# Altium schematic sheet SOC_PS_PSIO.SchDoc: Title
size 420 x 297 mm; Author: G.Kasprowicz; CompanyName: WUT ISE; DrawnBy: G.Kasprowicz; Organization: WUT ISE; Address1: PW ISE; Address2: Nowowiejska 15/19 00-665 Warsaw; Address3: gkasprow@gmail.com; DocumentNumber: 11; Revision: 2; SheetNumber: 11; SheetTotal: 40; ModifiedBy: -; CheckedDate: -; Title2: Title 2; DivGrp: WUT ISE; Designer: G.Kasprowicz; ModifiedDate: -; ProjectName: Sensor Box
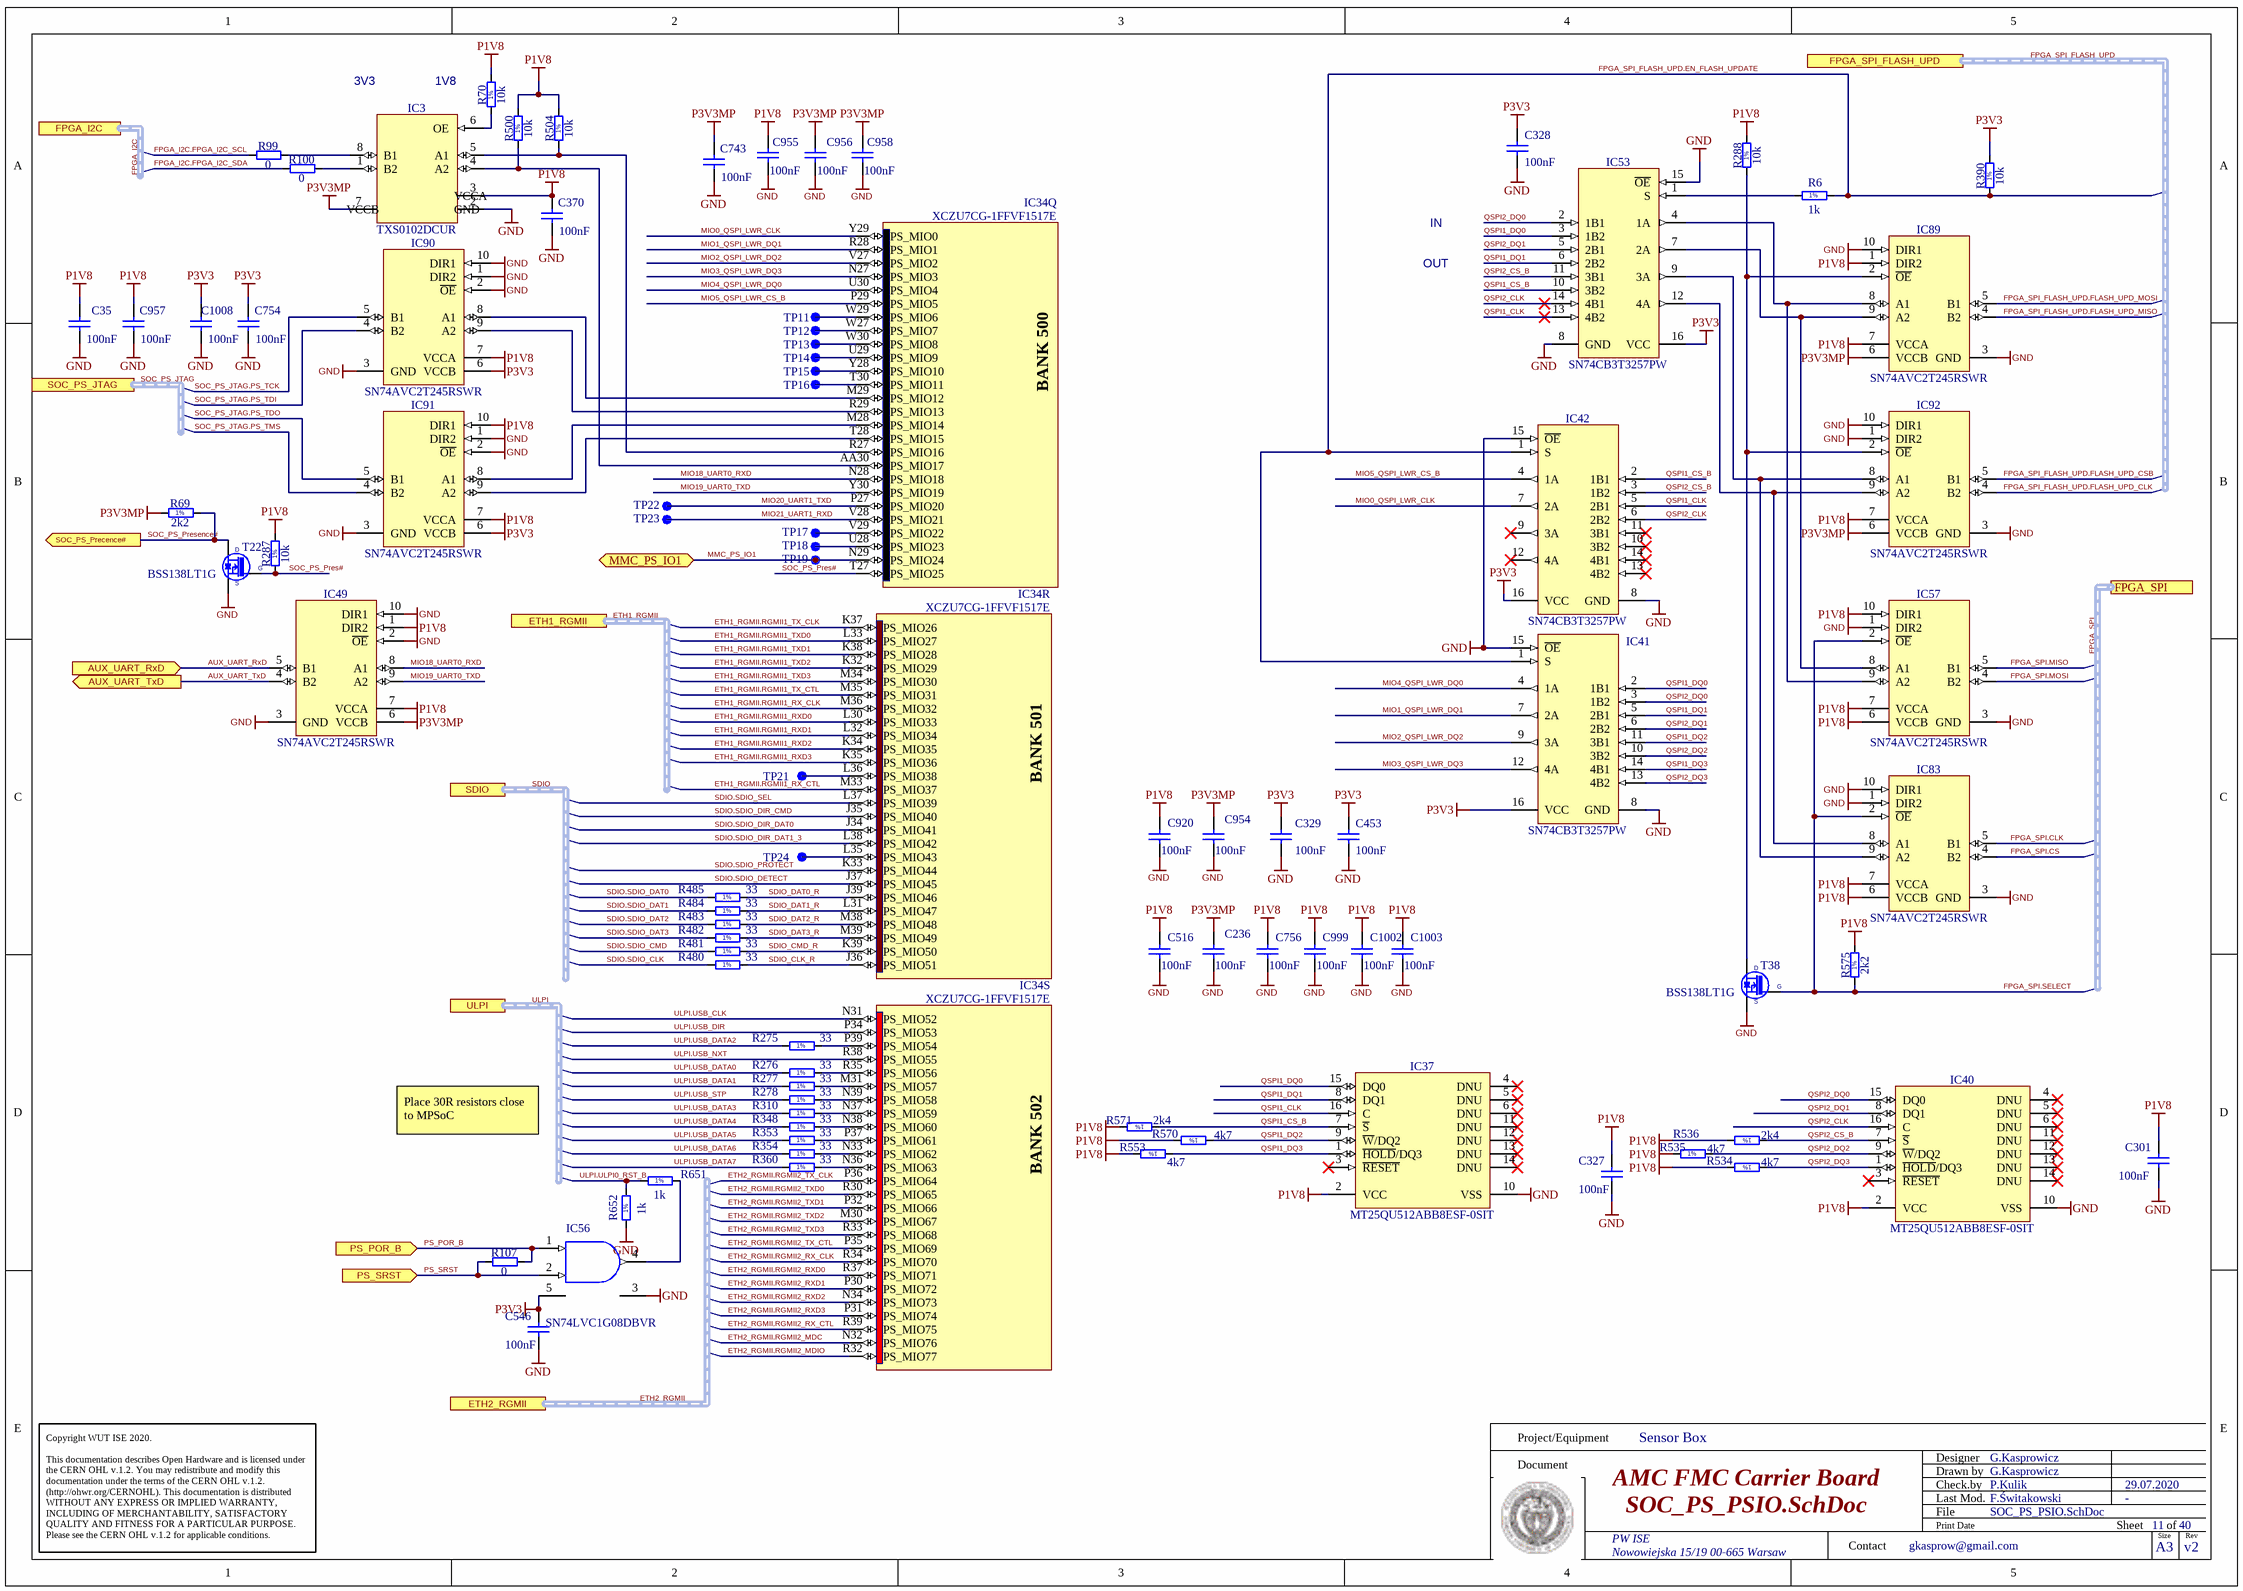
[diagram p0: SOC_PS_PSIO.SchDoc]

## Parts
C35  100nF  [CAPC0603X33N]
C236  100nF  [CAPC0603X33N]
C301  100nF  [CAPC0603X33N]
C327  100nF  [CAPC0603X33N]
C328  100nF  [CAPC0603X33N]
C329  100nF  [CAPC0603X33N]
C370  100nF  [CAPC0603X33N]
C453  100nF  [CAPC0603X33N]
C516  100nF  [CAPC0603X33N]
C546  100nF  [CAPC0603X33N]
C743  100nF  [CAPC0603X33N]
C754  100nF  [CAPC0603X33N]
C756  100nF  [CAPC0603X33N]
C920  100nF  [CAPC0603X33N]
C954  100nF  [CAPC0603X33N]
C955  100nF  [CAPC0603X33N]
C956  100nF  [CAPC0603X33N]
C957  100nF  [CAPC0603X33N]
C958  100nF  [CAPC0603X33N]
C999  100nF  [CAPC0603X33N]
C1002  100nF  [CAPC0603X33N]
C1003  100nF  [CAPC0603X33N]
C1008  100nF  [CAPC0603X33N]
IC3  TXS0102DCUR  [SOP50P310X90-8N]
IC34  XCZU7CG-1FFVF1517E  [BGA1517C100P39X39_4000X4000X351]  (parts Q,R,S of 28)
IC37  MT25QU512ABB8ESF-0SIT  [SOIC127P1030X265-16N]
IC40  MT25QU512ABB8ESF-0SIT  [SOIC127P1030X265-16N]
IC41  SN74CB3T3257PW  [SOP65P640X120-16N]
IC42  SN74CB3T3257PW  [SOP65P640X120-16N]
IC49  SN74AVC2T245RSWR  [QFN40P140X180X55-10N]
IC53  SN74CB3T3257PW  [SOP65P640X120-16N]
IC56  SN74LVC1G08DBVR  [SOT95P280X145-5N]
IC57  SN74AVC2T245RSWR  [QFN40P140X180X55-10N]
IC83  SN74AVC2T245RSWR  [QFN40P140X180X55-10N]
IC89  SN74AVC2T245RSWR  [QFN40P140X180X55-10N]
IC90  SN74AVC2T245RSWR  [QFN40P140X180X55-10N]
IC91  SN74AVC2T245RSWR  [QFN40P140X180X55-10N]
IC92  SN74AVC2T245RSWR  [QFN40P140X180X55-10N]
R6  1k  [RESC1005X40N]
R69  2k2  [RESC1005X40N]
R70  10k  [RESC1005X40N]
R99  0  [RESC1005X40N]
R100  0  [RESC1005X40N]
R107  0  [RESC1005X40N]
R275  33  [RESC1005X40N]
R276  33  [RESC1005X40N]
R277  33  [RESC1005X40N]
R278  33  [RESC1005X40N]
R287  10k  [RESC1005X40N]
R288  10k  [RESC1005X40N]
R310  33  [RESC1005X40N]
R348  33  [RESC1005X40N]
R353  33  [RESC1005X40N]
R354  33  [RESC1005X40N]
R360  33  [RESC1005X40N]
R390  10k  [RESC1005X40N]
R480  33  [RESC1005X40N]
R481  33  [RESC1005X40N]
R482  33  [RESC1005X40N]
R483  33  [RESC1005X40N]
R484  33  [RESC1005X40N]
R485  33  [RESC1005X40N]
R500  10k  [RESC1005X40N]
R504  10k  [RESC1005X40N]
R534  4k7  [RESC1005X40N]
R535  4k7  [RESC1005X40N]
R536  2k4  [RESC1005X40N]
R553  4k7  [RESC1005X40N]
R570  4k7  [RESC1005X40N]
R571  2k4  [RESC1005X40N]
R575  2k2  [RESC1005X40N]
R651  1k  [RESC1005X40N]
R652  1k  [RESC1005X40N]
T22  BSS138LT1G  [SOT95P240X110-3N]
T38  BSS138LT1G  [SOT95P240X110-3N]
TP11  SMD Pad  [C100]  (value not drawn)  (no BOM)
TP12  SMD Pad  [C100]  (value not drawn)  (no BOM)
TP13  SMD Pad  [C100]  (value not drawn)  (no BOM)
TP14  SMD Pad  [C100]  (value not drawn)  (no BOM)
TP15  SMD Pad  [C100]  (value not drawn)  (no BOM)
TP16  SMD Pad  [C100]  (value not drawn)  (no BOM)
TP17  SMD Pad  [C100]  (value not drawn)  (no BOM)
TP18  SMD Pad  [C100]  (value not drawn)  (no BOM)
TP19  SMD Pad  [C100]  (value not drawn)  (no BOM)
TP21  SMD Pad  [C100]  (value not drawn)  (no BOM)
TP22  SMD Pad  [C100]  (value not drawn)  (no BOM)
TP23  SMD Pad  [C100]  (value not drawn)  (no BOM)
TP24  SMD Pad  [C100]  (value not drawn)  (no BOM)

## Ports
AUX_UART_RxD (in), AUX_UART_TxD (out), ETH1_RGMII (harness ETH1_RGMII), ETH2_RGMII (harness ETH2_RGMII), FPGA_I2C (harness FPGA_I2C), FPGA_SPI (harness FPGA_SPI), FPGA_SPI_FLASH_UPD (harness FPGA_SPI_FLASH_UPD), MMC_PS_IO1 (bidir), PS_POR_B (in), PS_SRST (in), SDIO (harness SDIO), SOC_PS_JTAG (harness SOC_PS_JTAG), SOC_PS_Precence# (out), ULPI (harness ULPI)

## Nets
GND: C35.1 C236.1 C301.1 C327.1 C328.1 C329.1 C370.1 C453.1 C516.1 C546.1 C743.1 C754.1 C756.1 C920.1 C954.1 C955.1 C956.1 C957.1 C958.1 C999.1 C1002.1 C1003.1 C1008.1 IC3.2(GND) IC37.10(VSS) IC40.10(VSS) IC41.8(GND) IC41.15(~{OE}) IC42.8(GND) IC42.15(~{OE}) IC49.2(~{OE}) IC49.3(GND) IC49.10(DIR1) IC53.8(GND) IC53.15(~{OE}) IC56.3(GND) IC57.1(DIR2) IC57.3(GND) IC83.1(DIR2) IC83.3(GND) IC83.10(DIR1) IC89.3(GND) IC89.10(DIR1) IC90.1(DIR2) IC90.2(~{OE}) IC90.3(GND) IC90.10(DIR1) IC91.1(DIR2) IC91.2(~{OE}) IC91.3(GND) IC92.1(DIR2) IC92.3(GND) IC92.10(DIR1) R652.1 T22.2(S) T38.2(S)
P1V8: C35.2 C301.2 C327.2 C370.2 C516.2 C756.2 C920.2 C955.2 C957.2 C999.2 C1002.2 C1003.2 IC3.3(Vcca) IC37.2(VCC) IC40.2(VCC) IC49.1(DIR2) IC49.7(VCCA) IC57.6(VCCB) IC57.7(VCCA) IC57.10(DIR1) IC83.6(VCCB) IC83.7(VCCA) IC89.1(DIR2) IC89.7(VCCA) IC90.7(VCCA) IC91.7(VCCA) IC91.10(DIR1) IC92.7(VCCA) R70.2 R287.2 R288.2 R500.2 R504.2 R534.2 R535.1 R536.2 R553.2 R570.1 R571.2 R575.2
P3V3: C328.2 C329.2 C453.2 C546.2 C754.2 C1008.2 IC41.16(VCC) IC42.16(VCC) IC53.16(VCC) IC56.5(VCC) IC90.6(VCCB) IC91.6(VCCB) R390.2
P3V3MP: C236.2 C743.2 C954.2 C956.2 C958.2 IC3.7(Vccb) IC49.6(VCCB) IC89.6(VCCB) IC92.6(VCCB) R69.1
AUX_UART_RxD: IC49.5(B1) ; port AUX_UART_RxD
AUX_UART_TxD: IC49.4(B2) ; port AUX_UART_TxD
ETH1_RGMII.RGMII1_RX_CLK: IC34.M36(PS_MIO32)
ETH1_RGMII.RGMII1_RX_CTL: IC34.M33(PS_MIO37)
ETH1_RGMII.RGMII1_RXD0: IC34.L30(PS_MIO33)
ETH1_RGMII.RGMII1_RXD1: IC34.L32(PS_MIO34)
ETH1_RGMII.RGMII1_RXD2: IC34.K34(PS_MIO35)
ETH1_RGMII.RGMII1_RXD3: IC34.K35(PS_MIO36)
ETH1_RGMII.RGMII1_TX_CLK: IC34.K37(PS_MIO26)
ETH1_RGMII.RGMII1_TX_CTL: IC34.M35(PS_MIO31)
ETH1_RGMII.RGMII1_TXD0: IC34.L33(PS_MIO27)
ETH1_RGMII.RGMII1_TXD1: IC34.K38(PS_MIO28)
ETH1_RGMII.RGMII1_TXD2: IC34.K32(PS_MIO29)
ETH1_RGMII.RGMII1_TXD3: IC34.M34(PS_MIO30)
ETH2_RGMII.RGMII2_MDC: IC34.N32(PS_MIO76)
ETH2_RGMII.RGMII2_MDIO: IC34.R32(PS_MIO77)
ETH2_RGMII.RGMII2_RX_CLK: IC34.R34(PS_MIO70)
ETH2_RGMII.RGMII2_RX_CTL: IC34.R39(PS_MIO75)
ETH2_RGMII.RGMII2_RXD0: IC34.R37(PS_MIO71)
ETH2_RGMII.RGMII2_RXD1: IC34.P30(PS_MIO72)
ETH2_RGMII.RGMII2_RXD2: IC34.N34(PS_MIO73)
ETH2_RGMII.RGMII2_RXD3: IC34.P31(PS_MIO74)
ETH2_RGMII.RGMII2_TX_CLK: IC34.P36(PS_MIO64)
ETH2_RGMII.RGMII2_TX_CTL: IC34.P35(PS_MIO69)
ETH2_RGMII.RGMII2_TXD0: IC34.R30(PS_MIO65)
ETH2_RGMII.RGMII2_TXD1: IC34.P32(PS_MIO66)
ETH2_RGMII.RGMII2_TXD2: IC34.M30(PS_MIO67)
ETH2_RGMII.RGMII2_TXD3: IC34.R33(PS_MIO68)
FPGA_I2C.FPGA_I2C_SCL: R99.1
FPGA_I2C.FPGA_I2C_SDA: R100.1
FPGA_SPI.CLK: IC83.5(B1)
FPGA_SPI.CS: IC83.4(B2)
FPGA_SPI.MISO: IC57.5(B1)
FPGA_SPI.MOSI: IC57.4(B2)
FPGA_SPI.SELECT: IC57.2(~{OE}) IC83.2(~{OE}) R575.1 T38.1(G)
FPGA_SPI_FLASH_UPD.EN_FLASH_UPDATE: IC41.1(S) IC42.1(S) R6.2 R390.1
FPGA_SPI_FLASH_UPD.FLASH_UPD_CLK: IC92.4(B2)
FPGA_SPI_FLASH_UPD.FLASH_UPD_CSB: IC92.5(B1)
FPGA_SPI_FLASH_UPD.FLASH_UPD_MISO: IC89.4(B2)
FPGA_SPI_FLASH_UPD.FLASH_UPD_MOSI: IC89.5(B1)
MIO0_QSPI_LWR_CLK: IC34.Y29(PS_MIO0) IC42.7(2A)
MIO1_QSPI_LWR_DQ1: IC34.R28(PS_MIO1) IC41.7(2A)
MIO2_QSPI_LWR_DQ2: IC34.V27(PS_MIO2) IC41.9(3A)
MIO3_QSPI_LWR_DQ3: IC34.N27(PS_MIO3) IC41.12(4A)
MIO4_QSPI_LWR_DQ0: IC34.U30(PS_MIO4) IC41.4(1A)
MIO5_QSPI_LWR_CS_B: IC34.P29(PS_MIO5) IC42.4(1A)
MIO18_UART0_RXD: IC34.N28(PS_MIO18) IC49.8(A1)
MIO19_UART0_TXD: IC34.Y30(PS_MIO19) IC49.9(A2)
MIO20_UART1_TXD: IC34.P27(PS_MIO20) TP22.1
MIO21_UART1_RXD: IC34.V28(PS_MIO21) TP23.1
MMC_PS_IO1: IC34.N29(PS_MIO24) TP19.1 ; port MMC_PS_IO1
PS_POR_B: IC56.1(B) R107.2 ; port PS_POR_B
PS_SRST: IC56.2(A) R107.1 ; port PS_SRST
QSPI1_CLK: IC37.16(C) IC42.5(2B1) IC53.13(4B2)
QSPI1_CS_B: IC37.7(~{S}) IC42.2(1B1) IC53.10(3B2) R571.1
QSPI1_DQ0: IC37.15(DQ0) IC41.2(1B1) IC53.3(1B2)
QSPI1_DQ1: IC37.8(DQ1) IC41.5(2B1) IC53.6(2B2)
QSPI1_DQ2: IC37.9(~{W}/DQ2) IC41.11(3B1) R570.2
QSPI1_DQ3: IC37.1(~{HOLD}/DQ3) IC41.14(4B1) R553.1
QSPI2_CLK: IC40.16(C) IC42.6(2B2) IC53.14(4B1)
QSPI2_CS_B: IC40.7(~{S}) IC42.3(1B2) IC53.11(3B1) R536.1
QSPI2_DQ0: IC40.15(DQ0) IC41.3(1B2) IC53.2(1B1)
QSPI2_DQ1: IC40.8(DQ1) IC41.6(2B2) IC53.5(2B1)
QSPI2_DQ2: IC40.9(~{W}/DQ2) IC41.10(3B2) R535.2
QSPI2_DQ3: IC40.1(~{HOLD}/DQ3) IC41.13(4B2) R534.1
SDIO.SDIO_CLK: R480.1
SDIO.SDIO_CMD: R481.1
SDIO.SDIO_DAT0: R485.1
SDIO.SDIO_DAT1: R484.1
SDIO.SDIO_DAT2: R483.1
SDIO.SDIO_DAT3: R482.1
SDIO.SDIO_DETECT: IC34.J37(PS_MIO45)
SDIO.SDIO_DIR_CMD: IC34.J35(PS_MIO40)
SDIO.SDIO_DIR_DAT0: IC34.J34(PS_MIO41)
SDIO.SDIO_DIR_DAT1_3: IC34.L38(PS_MIO42)
SDIO.SDIO_PROTECT: IC34.K33(PS_MIO44)
SDIO.SDIO_SEL: IC34.L37(PS_MIO39)
SDIO_CLK_R: IC34.J36(PS_MIO51) R480.2
SDIO_CMD_R: IC34.K39(PS_MIO50) R481.2
SDIO_DAT0_R: IC34.J39(PS_MIO46) R485.2
SDIO_DAT1_R: IC34.L31(PS_MIO47) R484.2
SDIO_DAT2_R: IC34.M38(PS_MIO48) R483.2
SDIO_DAT3_R: IC34.M39(PS_MIO49) R482.2
SOC_PS_JTAG.PS_TCK: IC90.5(B1)
SOC_PS_JTAG.PS_TDI: IC90.4(B2)
SOC_PS_JTAG.PS_TDO: IC91.5(B1)
SOC_PS_JTAG.PS_TMS: IC91.4(B2)
SOC_PS_Pres#: IC34.T27(PS_MIO25) R287.1 T22.1(G)
SOC_PS_Presence#: R69.2 T22.3(D) ; port SOC_PS_Precence#
ULPI.ULPI0_RST_B: R651.1 R652.2
ULPI.USB_CLK: IC34.N31(PS_MIO52)
ULPI.USB_DATA0: R276.1
ULPI.USB_DATA1: R277.1
ULPI.USB_DATA2: R275.1
ULPI.USB_DATA3: R310.1
ULPI.USB_DATA4: R348.1
ULPI.USB_DATA5: R353.1
ULPI.USB_DATA6: R354.1
ULPI.USB_DATA7: R360.1
ULPI.USB_DIR: IC34.P34(PS_MIO53)
ULPI.USB_NXT: IC34.R38(PS_MIO55)
ULPI.USB_STP: R278.1
NetIC3_1: IC3.1(B2) R100.2
NetIC3_4: IC3.4(A2) IC34.AA30(PS_MIO17) R500.1
NetIC3_5: IC3.5(A1) IC34.R27(PS_MIO16) R504.1
NetIC3_6: IC3.6(OE) R70.1
NetIC3_8: IC3.8(B1) R99.2
NetIC34_L35: IC34.L35(PS_MIO43) TP24.1
NetIC34_L36: IC34.L36(PS_MIO38) TP21.1
NetIC34_M28: IC34.M28(PS_MIO14) IC91.8(A1)
NetIC34_M29: IC34.M29(PS_MIO12) IC90.8(A1)
NetIC34_M31: IC34.M31(PS_MIO57) R277.2
NetIC34_N33: IC34.N33(PS_MIO62) R354.2
NetIC34_N36: IC34.N36(PS_MIO63) R360.2
NetIC34_N37: IC34.N37(PS_MIO59) R310.2
NetIC34_N38: IC34.N38(PS_MIO60) R348.2
NetIC34_N39: IC34.N39(PS_MIO58) R278.2
NetIC34_P37: IC34.P37(PS_MIO61) R353.2
NetIC34_P39: IC34.P39(PS_MIO54) R275.2
NetIC34_R29: IC34.R29(PS_MIO13) IC90.9(A2)
NetIC34_R35: IC34.R35(PS_MIO56) R276.2
NetIC34_T28: IC34.T28(PS_MIO15) IC91.9(A2)
NetIC34_T30: IC34.T30(PS_MIO11) TP16.1
NetIC34_U28: IC34.U28(PS_MIO23) TP18.1
NetIC34_U29: IC34.U29(PS_MIO9) TP14.1
NetIC34_V29: IC34.V29(PS_MIO22) TP17.1
NetIC34_W27: IC34.W27(PS_MIO7) TP12.1
NetIC34_W29: IC34.W29(PS_MIO6) TP11.1
NetIC34_W30: IC34.W30(PS_MIO8) TP13.1
NetIC34_Y28: IC34.Y28(PS_MIO10) TP15.1
NetIC53_1: IC53.1(S) R6.1
NetIC53_4: IC53.4(1A) IC57.9(A2) IC89.8(A1)
NetIC53_7: IC53.7(2A) IC57.8(A1) IC89.9(A2)
NetIC53_9: IC53.9(3A) IC83.9(A2) IC92.8(A1)
NetIC53_12: IC53.12(4A) IC83.8(A1) IC92.9(A2)
NetIC56_4: IC56.4(Y) R651.2
NetIC89_2: IC89.2(~{OE}) IC92.2(~{OE}) R288.1 T38.3(D)

Not connected (* = marked no-connect by the designer): IC37 3(~{RESET})* 4(DNU)* 5(DNU)* 6(DNU)* 11(DNU)* 12(DNU)* 13(DNU)* 14(DNU)*; IC40 3(~{RESET})* 4(DNU)* 5(DNU)* 6(DNU)* 11(DNU)* 12(DNU)* 13(DNU)* 14(DNU)*; IC42 9(3A)* 10(3B2)* 11(3B1)* 12(4A)* 13(4B2)* 14(4B1)*

## Buses and harness runs
harness ETH1_RGMII = port ETH1_RGMII
harness ETH2_RGMII = port ETH2_RGMII
harness FPGA_I2C = port FPGA_I2C
harness FPGA_SPI = port FPGA_SPI
harness FPGA_SPI_FLASH_UPD = port FPGA_SPI_FLASH_UPD
harness SDIO = port SDIO
harness SOC_PS_JTAG = port SOC_PS_JTAG
harness ULPI = port ULPI

## Notes on the sheet
- (near IC3) 3V3
- 1V8
- OUT
- IN
- Place 30R resistors close to MPSoC
- Project/Equipment
- Document
- AMC FMC Carrier Board
- Designer
- Drawn by
- Check.by
- P.Kulik
- 29.07.2020
- Copyright WUT ISE 2020.
  This documentation describes Open Hardware and is licensed under the CERN OHL v.1.2. You may redistribute and modify this documentation under the terms of the CERN OHL v.1.2. (http://ohwr.org/CERNOHL). This documentation is distributed WITHOUT ANY EXPRESS OR IMPLIED WARRANTY, INCLUDING OF MERCHANTABILITY, SATISFACTORY QUALITY AND FITNESS FOR A PARTICULAR PURPOSE. Please see the CERN OHL v.1.2 for applicable conditions.
- Contact
- File
- Last Mod.
- Print Date
- F.Świtakowski
- Sheet
- Size
- A3
- of
- v2
- Rev
- (in symbol R0402_1K_1%_0.0625W_100PPM) 1%
- (in symbol R0402_2K2_1%_0.0625W_100PPM) 1%
- (in symbol R0402_2K4_1%_0.0625W_100PPM) 1%
- (in symbol R0402_4K7_1%_0.0625W_100PPM) 1%
- (in symbol R0402_10K_1%_0.0625W_100PPM) 1%
- (in symbol R0402_33R_1%_0.0625W_100PPM) 1%
- (in symbol TXS0102DCUR) VCCA; VCCB
- (in symbol XCZU7CG-1FFVF1517E, part Q) BANK 500
- (in symbol XCZU7CG-1FFVF1517E, part R) BANK 501
- (in symbol XCZU7CG-1FFVF1517E, part S) BANK 502

## Library data of the parts
C35 C236 C301 C327 C370 C516 C546 C743 C754 C756 C920 C954-C958 C999 C1002 C1003 C1008 = CC0201_100NF_6.3V_10%_X5R: Non-polarised capacitor; Manufacturer: GENERIC; Part Description: SMD Multilayer Chip Ceramic Capacitor; Manufacturer1 Part Number: 02016D104KAT2A; Tolerance: ±10%; Voltage: 6.3V; TC: X5R; Manufacturer Part Number: CC0201_100NF_6.3V_10%_X5R; Part Number: CC0201_100NF_6.3V_10%_X5R; Value: 100nF; Component Kind: Standard; Component Type: Standard; Pin Count: 2; Status: Not Recommended; Case: 0201; Mounted: Yes; Socket: No; SMD: Yes; Sense: No; Manufacturer1 Example: AVX; Manufacturer1 ComponentHeight: 0.33mm; HelpURL: \\cern.ch\dfs\Applications\Altium\Datasheets\CC0201_X5R_AVX.pdf; Author: CERN DEM JLC; CreateDate: 03/12/2007; LatestRevisionDate: 03/12/2007
C328 C329 C453 = CC0201_100NF_6.3V_10%_X5R: Non-polarised capacitor; Manufacturer: GENERIC; Manufacturer1 Part Number: 02016D104KAT2A; Part Description: SMD Multilayer Chip Ceramic Capacitor; TC: X5R; Tolerance: ±10%; Voltage: 6.3V; Author: CERN DEM JLC; Case: 0201; Component Kind: Standard; Component Type: Standard; CreateDate: 03/12/2007; HelpURL: \\cern.ch\dfs\Applications\Altium\Datasheets\CC0201_X5R_AVX.pdf; LatestRevisionDate: 03/12/2007; Manufacturer Part Number: CC0201_100NF_6.3V_10%_X5R; Manufacturer1 ComponentHeight: 0.33mm; Manufacturer1 Example: AVX; Mounted: Yes; Part Number: CC0201_100NF_6.3V_10%_X5R; Pin Count: 2; SMD: Yes; Socket: No; Status: Not Recommended; Value: 100nF; Sense: No
IC3 = TXS0102DCUR: 2-Bit Bidirectionnal Voltage-Level Translator for Open-Drain And Push-Pull Applications; Manufacturer: TEXAS INSTRUMENTS; PressFit: No; Bonding: No; Manufacturer Part Number: TXS0102DCUR; PackageDescription: SOP, 0.50mm Pitch; 8 pin, 2.30mm W X 2.00mm L X 0.90mm H body, PC Medium Density; Part Description: 2-Bit Bidirectionnal Voltage-Level Translator for Open-Drain And Push-Pull Applications; Part Number: TXS0102DCUR; Component Kind: Standard; Component Type: Standard; Device: TXS0102DCUR; Pin Count: 8; Case: TSSOP8; Mounted: Yes; Socket: No; SMD: Yes; Sense: No; ComponentHeight: 0.9mm; Author: CERN DEM JLC; HelpURL: \\cern.ch\dfs\Applications\Altium\Datasheets\TXS0102DCUR.pdf; CreateDate: 08.07.2014; LatestRevisionDate: 08.07.2014
IC34 = XCZU7CG-1FFVF1517E: Zynq UltraScale+ RFSoC, Quad-Core ARM® Cortex™-A53 MPCore™ up to 1.5GHz, 214 PS I/O, 416 HP I/O, 48 HD I/O, 1517-Pin BGA; Part Description: Zynq UltraScale+ MPSoC, Quad-Core ARM® Cortex™-A53 MPCore™ up to 1.5GHz, 214 PS I/O, 416 HP I/O, 48 HD I/O, 1517-Pin BGA; Manufacturer: XILINX; PressFit: No; Bonding: No; Part Number: XCZU7CG-1FFVF1517E; Component Kind: Standard; Component Type: Standard; Device: XCZU7CG-1FFVF1517E; PackageDescription: BGA, 1.00mm Pitch, Square; 1517 Pin, 39 Columns X 39 Rows, Body 40.00mm X 40.00mm X 3.51mm H, IPC Medium Density; Manufacturer Part Number: XCZU7CG-1FFVF1517E; Pin Count: 1517; Case: BGA1517; Mounted: Yes; Socket: No; SMD: Yes; Sense: No; ComponentHeight: 3.51mm; HelpURL: \\cern.ch\dfs\Applications\Altium\Datasheets\XCZU7CG-1FFVF1517E.pdf; ComponentLink1URL: \\cern.ch\dfs\Applications\Altium\Datasheets\XCZU7CG-1FFVF1517E_Package-Pinout.pdf; ComponentLink1Description: Package/Pinout; ComponentLink2URL: \\cern.ch\dfs\Applications\Altium\Datasheets\XCZU7CG-1FFVF1517E_Pinout.pdf; ComponentLink2Description: Pinout; Author: CERN DEM BC; CreateDate: 10.07.2019; LatestRevisionDate: 10.07.2019
IC37 IC40 = MT25QU512ABB8ESF-0SIT: 512Mbit (64MB), 1.8V, Multiple I/O Serial Flash Memory, Reset# & Hold# Pins; Manufacturer: MICRON TECHNOLOGY; PressFit: No; Bonding: No; Part Number: MT25QU512ABB8ESF-0SIT; Component Kind: Standard; Component Type: Standard; Device: MT25QU512ABB8ESF-0SIT; PackageDescription: SOIC 16, Pitch 1.27mm - Body 7.5x10.3mm, IPC Medium Density; Part Description: 512Mbit (64MB), 1.8V, Multiple I/O Serial Flash Memory, Reset# & Hold# Pins; Manufacturer Part Number: MT25QU512ABB8ESF-0SIT; Pin Count: 16; Case: SOIC16; Mounted: Yes; Socket: No; SMD: Yes; Sense: No; ComponentHeight: 2.65mm; HelpURL: \\cern.ch\dfs\Applications\Altium\Datasheets\MT25QU512ABB8ESF.pdf; Author: CERN DEM MR; CreateDate: 03.06.2016; LatestRevisionDate: 03.06.2016
IC41 IC42 IC53 = SN74CB3T3257PW: 4-BIT 1-OF-2 FET Multiplexer/Demultiplexer 2.5V/3.3V Low-Voltage Bus Switch 5V Tolerant Shifter; Manufacturer: TEXAS INSTRUMENTS; PressFit: No; Bonding: No; Manufacturer Part Number: SN74CB3T3257PW; PackageDescription: SOP, 0.65mm pitch; 16 pin, 4.40mm W X 5.00mm L X 1.20mm H body IPC Medium Density; Part Description: 4-Bit 1-of-2 FET Multiplexer/Demultiplexer 2.5V/3.3V Low-Voltage Bus Switch 5V Tolerant Shifter; Part Number: SN74CB3T3257PW; Component Kind: Standard; Component Type: Standard; Device: SN74CB3T3257PW; Pin Count: 16; Case: TSSOP16; Mounted: Yes; Socket: No; SMD: Yes; Sense: No; ComponentHeight: 1.2mm; Author: CERN DEM JLC; HelpURL: \\cern.ch\dfs\Applications\Altium\Datasheets\SN74CB3T3257PW.pdf; CreateDate: 30.01.2012; LatestRevisionDate: 30.01.2012
IC49 IC57 IC83 IC89-IC92 = SN74AVC2T245RSWR: Dual-Bit Dual-Supply Bus Transceiver With Configurable Voltage Translation and 3-State Outputs; Manufacturer: TEXAS INSTRUMENTS; PressFit: No; Bonding: No; Manufacturer Part Number: SN74AVC2T245RSWR; PackageDescription: QFN, 0.40mm Pitch, Rect.;10 Pin, 1.80mm L X 1.40mm W X 0.55mm H Body, IPC Medium Density; Part Description: Dual-Bit Dual-Supply Bus Transceiver With Configurable Voltage Translation and 3-State Outputs; Part Number: SN74AVC2T245RSWR; Component Kind: Standard; Component Type: Standard; Device: SN74AVC2T245RSWR; Status: Not Recommended; Pin Count: 10; Case: QFN10; Mounted: Yes; Socket: No; SMD: Yes; Sense: No; ComponentHeight: 0.55mm; Author: CERN DEM JLC; HelpURL: \\cern.ch\dfs\Applications\Altium\Datasheets\SN74AVC2T245RSWR.pdf; CreateDate: 07.07.2014; LatestRevisionDate: 30.03.2017
IC56 = SN74LVC1G08DBVR: Single 2-Input AND Gate; Part Description: Single 2-Input Positive-AND Gate; Manufacturer: TEXAS INSTRUMENTS; PressFit: No; Bonding: No; Part Number: SN74LVC1G08DBVR; Component Kind: Standard; Component Type: Standard; Device: SN74LVC1G08DBVR; PackageDescription: SOT, 0.95mm pitch; 5 pin, 1.60mm W X 2.90mm L X 1.45mm H body, IPC Medium Density; Manufacturer Part Number: SN74LVC1G08DBVR; Pin Count: 5; Case: SOT23-5; Mounted: Yes; Socket: No; SMD: Yes; Sense: No; ComponentHeight: 1.45mm; Author: CERN DEM JLC; HelpURL: \\cern.ch\dfs\Applications\Altium\Datasheets\SN74LVC1G08DBVR.pdf; CreateDate: 28.08.2012; LatestRevisionDate: 28.08.2012
R6 R651 R652 = R0402_1K_1%_0.0625W_100PPM: Resistor - 1%; Manufacturer: GENERIC; Part Description: General Purpose Thick Film Chip Resistor; Manufacturer1 Part Number: 232270671002L; TC: ±100ppm/°C; PressFit: No; Manufacturer Part Number: R0402_1K_1%_0.0625W_100PPM; Part Number: R0402_1K_1%_0.0625W_100PPM; Tolerance: ±1%; Value: 1k; Component Kind: Standard; Component Type: Standard; Pin Count: 2; Status: Not Recommended; Power: 0.0625W; Case: 0402; Mounted: Yes; Sense: No; Socket: No; SMD: Yes; Manufacturer1 Example: YAGEO PHYCOMP; Manufacturer1 ComponentHeight: 0.4mm; HelpURL: \\cern.ch\dfs\Applications\Altium\Datasheets\R0402_Phycomp_RC0402.pdf; Author: CERN DEM JLC; CreateDate: 03/12/2007; LatestRevisionDate: 17/10/2012
R69 R575 = R0402_2K2_1%_0.0625W_100PPM: Resistor - 1%; Part Description: General Purpose Thick Film Chip Resistor; Manufacturer: GENERIC; Manufacturer1 Part Number: 232270672202L; TC: ±100ppm/°C; PressFit: No; Part Number: R0402_2K2_1%_0.0625W_100PPM; Component Kind: Standard; Component Type: Standard; Pin Count: 2; Value: 2k2; Status: Not Recommended; Power: 0.0625W; Tolerance: ±1%; Manufacturer Part Number: R0402_2K2_1%_0.0625W_100PPM; Case: 0402; Mounted: Yes; Sense: No; Socket: No; SMD: Yes; Manufacturer1 Example: YAGEO PHYCOMP; Manufacturer1 ComponentHeight: 0.4mm; HelpURL: \\cern.ch\dfs\Applications\Altium\Datasheets\R0402_Phycomp_RC0402.pdf; Author: CERN DEM JLC; CreateDate: 03.12.2007; LatestRevisionDate: 17.10.2012
R70 R287 R288 R390 R500 R504 = R0402_10K_1%_0.0625W_100PPM: Resistor - 1%; Part Description: General Purpose Thick Film Chip Resistor; Manufacturer: GENERIC; Manufacturer1 Part Number: 232270671003L; TC: ±100ppm/°C; PressFit: No; Part Number: R0402_10K_1%_0.0625W_100PPM; Component Kind: Standard; Component Type: Standard; Pin Count: 2; Value: 10k; Status: Not Recommended; Power: 0.0625W; Tolerance: ±1%; Manufacturer Part Number: R0402_10K_1%_0.0625W_100PPM; Case: 0402; Mounted: Yes; Sense: No; Socket: No; SMD: Yes; Manufacturer1 Example: YAGEO PHYCOMP; Manufacturer1 ComponentHeight: 0.4mm; HelpURL: \\cern.ch\dfs\Applications\Altium\Datasheets\R0402_Phycomp_RC0402.pdf; Author: CERN DEM JLC; CreateDate: 03.12.2007; LatestRevisionDate: 17.10.2012
R99 R100 R107 = R0402_0R_JUMPER: Resistor; Part Description: 1A (0.05R Max DC Resistance) Zero Ohm Jumper; Manufacturer: GENERIC; Manufacturer1 Part Number: 232270591001L; PressFit: No; Part Number: R0402_0R_JUMPER; Component Kind: Standard; Component Type: Standard; Pin Count: 2; Value: 0; Status: Not Recommended; Manufacturer Part Number: R0402_0R_JUMPER; Case: 0402; Mounted: Yes; Sense: No; Socket: No; SMD: Yes; Manufacturer1 Example: YAGEO PHYCOMP; Manufacturer1 ComponentHeight: 0.4mm; HelpURL: \\cern.ch\dfs\Applications\Altium\Datasheets\R0402_Phycomp_RC0402.pdf; Author: CERN DEM JLC; CreateDate: 03.12.2007; LatestRevisionDate: 17.10.2012
R275-R278 R310 R348 R353 R354 R360 R480-R485 = R0402_33R_1%_0.0625W_100PPM: Resistor - 1%; Manufacturer: GENERIC; Part Description: General Purpose Thick Film Chip Resistor; Manufacturer1 Part Number: 232270673309L; TC: ±100ppm/°C; PressFit: No; Manufacturer Part Number: R0402_33R_1%_0.0625W_100PPM; Part Number: R0402_33R_1%_0.0625W_100PPM; Tolerance: ±1%; Value: 33; Component Kind: Standard; Component Type: Standard; Pin Count: 2; Status: Not Recommended; Power: 0.0625W; Case: 0402; Mounted: Yes; Sense: No; Socket: No; SMD: Yes; Manufacturer1 Example: YAGEO PHYCOMP; Manufacturer1 ComponentHeight: 0.4mm; HelpURL: \\cern.ch\dfs\Applications\Altium\Datasheets\R0402_Phycomp_RC0402.pdf; Author: CERN DEM JLC; CreateDate: 03/12/2007; LatestRevisionDate: 17/10/2012
R534 R535 R553 R570 = R0402_4K7_1%_0.0625W_100PPM: Resistor - 1%; Manufacturer: GENERIC; Part Description: General Purpose Thick Film Chip Resistor; Manufacturer1 Part Number: 232270674702L; TC: ±100ppm/°C; PressFit: No; Manufacturer Part Number: R0402_4K7_1%_0.0625W_100PPM; Part Number: R0402_4K7_1%_0.0625W_100PPM; Tolerance: ±1%; Value: 4k7; Component Kind: Standard; Component Type: Standard; Pin Count: 2; Status: Not Recommended; Power: 0.0625W; Case: 0402; Mounted: Yes; Sense: No; Socket: No; SMD: Yes; Manufacturer1 Example: YAGEO PHYCOMP; Manufacturer1 ComponentHeight: 0.4mm; HelpURL: \\cern.ch\dfs\Applications\Altium\Datasheets\R0402_Phycomp_RC0402.pdf; Author: CERN DEM JLC; CreateDate: 03/12/2007; LatestRevisionDate: 17/10/2012
R536 R571 = R0402_2K4_1%_0.0625W_100PPM: Resistor - 1%; Manufacturer: GENERIC; Part Description: General Purpose Thick Film Chip Resistor; Manufacturer1 Part Number: 232270672402L; TC: ±100ppm/°C; PressFit: No; Manufacturer Part Number: R0402_2K4_1%_0.0625W_100PPM; Part Number: R0402_2K4_1%_0.0625W_100PPM; Tolerance: ±1%; Value: 2k4; Component Kind: Standard; Component Type: Standard; Pin Count: 2; Status: Not Recommended; Power: 0.0625W; Case: 0402; Mounted: Yes; Sense: No; Socket: No; SMD: Yes; Manufacturer1 Example: YAGEO PHYCOMP; Manufacturer1 ComponentHeight: 0.4mm; HelpURL: \\cern.ch\dfs\Applications\Altium\Datasheets\R0402_Phycomp_RC0402.pdf; Author: CERN DEM JLC; CreateDate: 03/12/2007; LatestRevisionDate: 17/10/2012
T22 T38 = BSS138LT1G: N-CHANNEL MOSFET WITH DIODE; Manufacturer: ON SEMICONDUCTOR; Part Description: 50V 200mA N-Channel Enhancement Mode Field-Effect Transistor; PressFit: No; Bonding: No; Manufacturer Part Number: BSS138LT1G; PackageDescription: SOT23 3-Leads, Pitch 0.95mm - Body 1.4x3mm, IPC Medium Density; Part Number: BSS138LT1G; Component Kind: Standard; Component Type: Standard; Device: BSS138LT1G; Pin Count: 3; Case: SOT23-3; Mounted: Yes; Socket: No; SMD: Yes; Sense: No; ComponentHeight: 1.11mm; HelpURL: \\cern.ch\dfs\Applications\Altium\Datasheets\BSS138LT1G.pdf; Author: CERN DEM JLC; CreateDate: 23.03.2009; LatestRevisionDate: 23.03.2009
TP11-TP19 TP21-TP24 = SMD_PAD_D1MM: Through Hole Pad; Part Description: 1mm Diameter SMD Pad; Mounted: No; PackageDescription: 1mm Diameter SMD Pad; Part Number: SMD_PAD_D1MM; Component Type: Standard (No BOM); Pin Count: 1; Family: SMD Pad; Socket: No; SMD: No; Sense: No; Status: None; ComponentHeight: 0mm; HelpURL: Undefined; Author: CERN DEM JLC; CreateDate: 10/10/2017; LatestRevisionDate: 10/10/2017